# EAGLE board Mk4 Final a (EAGLE 9.0.1), part 2 of 3
## Tracks (layer width: path | path; a pad name or v marks a point on that pad's centre or on a via) (continued)
CC_!HIB  (via drill 0.3) (continued)
  Top 0.15: v30.8,31.2 32.28,31.2 arc45 33.52,31.71 34.87,33.07 arc-45 36.64,33.8 56.85,33.8 arc45 58.09,34.31 60.51,36.73 arc45 60.8,37.44 60.8,37.89 arc-45 60.95,38.25 61.15,38.45 arc45 61.3,38.81 61.3,39.1 arc-90 61.8,39.6 62.69,39.6 arc45 63.39,39.89 63.53,40.03 arc45 63.83,40.74 63.83,40.97 63.8,40.99 arc45 63.62,41.44 63.39,41.66 arc-45 63.1,42.37 63.1,46.46 arc-45 63.02,46.64 63.02,46.86 arc-45 63.1,47.04 63.1,47.29 arc-45 63.25,47.65 v63.9,48.3
  Bottom 0.15: IC15.2 20.55,17.7 arc45 20.69,17.36 21.67,16.38 arc45 21.98,16.25 23.59,16.25 arc45 23.95,16.4 R25.1 24.68,16.37 arc45 25.03,16.23 26.1,16.23 arc90 26.6,16.73 26.6,18.5 arc-45 27.19,19.91 28.61,21.33 arc45 28.9,22.04 28.9,28.89 arc-45 29.19,29.59 v30.8,31.2 | IC1.124 65.02,48.4 arc-45 64.88,48.46 64.88,48.47 arc45 64.73,48.52 64.33,48.52 arc45 63.98,48.38 v63.9,48.3
CC_!RESET  (via drill 0.3)
  Top 0.15: v61,48.5 61,47.95 arc45 61.15,47.6 61.18,47.56 arc-45 61.32,47.21 61.32,47.09 arc-45 61.25,46.9 arc45 61.1,46.55 61.1,46.54 arc-45 60.95,46.19 58.65,43.89 arc90 58.65,42.12 60.11,40.67 arc-45 60.4,39.96 60.4,39.41 arc-45 60.25,39.05 60.05,38.85 arc45 59.9,38.49 59.9,38.22 arc-45 59.31,36.81 57.5,34.99 arc-45 56.79,34.7 36.58,34.7 arc45 34.38,33.85 33.43,32.89 arc-45 32.72,32.6 30.1,32.6 arc-90 29.6,33.1 29.6,33.51 arc90 JP5.4 28.19,34.91 arc45 27.49,35.2 24.93,35.2 arc45 24.58,35.05 24.06,34.53 arc-45 23.74,34.4 arc45 23.38,34.25 23.08,33.95 arc-90 22.72,33.95 21.36,35.31 arc45 20.66,35.6 19.61,35.6 arc45 18.91,35.31 18.29,34.69 arc-45 17.59,34.4 8.7,34.4 arc90 7.2,32.9 7.2,30.34 v7.3,30.24 v7.3,30.25
  Bottom 0.15: IC1.12 61.6,47.69 arc45 61.45,48.05 v61,48.5
  Bottom 0.2: IC15.32 12.55,26.25 12.34,26.46 arc-45 12.05,27.16 12.05,27.5 arc90 11.05,28.5 R73.1 C60.2 arc-90 7.3,29.25 v7.3,30.25
CC_!RTS
  Bottom 0.2: IC15.50 22.84,25.75 arc-45 23.2,25.6 23.45,25.35 arc45 23.81,25.2 25.85,25.2 arc90 26.35,25.7 26.35,25.8 R70.1
CC_IRQ  (via drill 0.3)
  Top 0.15: v14.05,17.44 14.07,17.41 14.07,17.23 16.36,14.94 arc45 17.06,14.65 25.95,14.65 arc90 27.2,15.9 arc-45 27.71,17.14 27.76,17.18 arc45 28.2,18.25 28.2,19.6 arc-45 28.79,21.01 29.92,22.15 arc45 30.36,23.21 30.36,26.02 arc-45 30.66,26.73 35.79,31.86 arc-45 36.85,32.3 57.49,32.3 arc-45 58.19,32.01 58.71,31.49 arc45 59.41,31.2 59.69,31.2 arc45 60.39,31.49 62.01,33.11 arc45 62.3,33.81 62.3,37.68 arc-45 62.74,38.74 63.76,39.76 arc45 64.12,40.64 64.12,41.09 64.1,41.12 arc45 63.92,41.56 63.69,41.78 arc-45 63.4,42.49 63.4,45.44 arc-45 63.69,46.15 63.93,46.39 arc45 64.08,46.74 64.08,47.27 arc-45 64.22,47.62 v64.6,48
  Bottom 0.15: R72.1 14.05,15.75 v14.05,17.44 IC15.15 | IC1.123 66.62,48.8 arc45 66.58,48.78 arc-45 66.44,48.73 66.16,48.73 arc-45 66.02,48.78 65.97,48.84 arc45 65.83,48.9 63.88,48.9 arc90 63.38,48.4 63.38,48.2 arc90 63.88,47.7 64.3,47.7 v64.6,48
CC_RCT_XTAL_N
  Bottom 0.25: C100.2 25.85,21.25 X3.P$1 25.05,21.2 arc-90 24.55,21.7 24.55,23.44 arc45 24.4,23.8 23.95,24.25 arc45 23.59,24.4 23.36,24.4 arc-45 23,24.55 22.95,24.6 arc45 22.59,24.75 IC15.52
CC_RESERVED@19
  Bottom 0.15: IC15.19 12.52,19.75 arc90 12.27,19.5 12.27,18.53 12.8,18.01 R65.1
CC_RTC_XTAL_P
  Bottom 0.25: C101.2 25.85,24.25 X3.P$2 24.71,24.3 arc-45 24.35,24.45 24.12,24.68 arc45 23.77,24.82 23.65,24.82 arc-45 23.3,24.97 23.17,25.1 arc45 22.81,25.25 IC15.51
CC_TEST62
  Bottom 0.15: IC15.62 22.12,19.75 arc-90 22.32,19.55 22.32,17.27 TP19.TP
CC_WLAN_XTAL_
  Bottom 0.15: X4.3 7.67,18.32 8.31,18.96 arc-45 9.01,19.25 9.84,19.25 arc-45 10.54,18.96 C99.2 arc90 11.67,19.68 11.67,20.5 arc-90 12.42,21.25 IC15.22
CC_WLAN_XTAL_P
  Bottom 0.15: X4.1 10.17,19.75 C98.2 arc90 11.37,20.38 11.37,20.75 arc-90 12.37,21.75 IC15.23
DCDC_ANA_SW
  Bottom 0.25: 16.05,30.7 IC15.38
  Bottom 0.4: L7.2 15.4,32.21 arc45 15.69,31.51 15.76,31.44 arc-45 16.05,30.74 16.05,30.7
DCDC_DIG_SW
  Bottom 0.25: IC15.43 18.55,27.79 arc-45 18.84,28.49 19.36,29.01 arc45 19.65,29.71 arc-45 19.92,30.37 20.01,30.46 arc-45 20.71,30.75 23.65,30.75 L9.2
DCDC_PA_SW_N
  Bottom 0.25: IC15.41 17.55,28.29 arc-45 17.84,28.99 18.55,29.7
  Bottom 0.3: 18.55,29.7 18.55,29.76 18.8,30.01 18.8,32 18.9,32.1
  Bottom 0.5: 18.9,32.1 18.9,33.59 arc45 18.75,33.95 18.1,34.6 L8.1
DCDC_PA_SW_P
  Bottom 0.25: IC15.40 17.05,28.55 arc-45 17.34,29.26 18.25,30.17
  Bottom 0.4: L8.2 18.25,32.4 18.25,30.17
EN0RXI_N
  Bottom 0.22: IC1.53 51.21,54.8 51.2,54.81 48.9,54.81 arc-90 46.61,57.1 46.61,64.8 arc-90 50,68.19 56.1,68.19 arc90 57.02,69.1 57.02,69.6 JP7.6
EN0RXI_P
  Bottom 0.22: IC1.54 51.21,55.2 51.2,55.19 48.9,55.19 arc-90 46.98,57.1 46.98,64.8 arc-90 50,67.81 56.1,67.81 arc90 57.38,69.1 57.38,69.23 JP7.7
EN0TXO_N
  Bottom 0.22: IC1.56 51.21,56 51.2,56.02 49.05,56.02 arc-90 47.66,57.4 47.66,64.45 arc-90 50.4,67.19 56.41,67.19 arc45 57.12,67.48 58.33,68.69 arc-45 59.04,68.98 66.16,68.98 arc-45 66.87,68.69 67.83,67.73 arc45 68.54,67.44 70.95,67.44 arc90 72.31,68.8 72.31,69.54 JP7.12
EN0TXO_P
  Bottom 0.22: IC1.57 51.21,56.4 51.2,56.38 49.05,56.38 arc-90 48.03,57.4 48.03,64.45 arc-90 50.4,66.81 56.56,66.81 arc45 57.27,67.11 58.48,68.32 arc-45 59.19,68.61 66.01,68.61 arc-45 66.72,68.32 67.68,67.36 arc45 68.39,67.06 70.95,67.06 arc90 72.69,68.8 72.69,69.29 JP7.13
ETHLED0
  Bottom 0.15: R1.2 44.3,66.51 arc45 44.59,65.81 45.31,65.09 arc-45 45.6,64.39 45.6,61.94 45.69,61.85 arc-90 45.69,61.15 45.6,61.06 45.6,57.19 45.69,57.1 arc-90 45.69,56.4 45.6,56.31 45.6,54.11 arc45 45.89,53.41 46.41,52.89 arc-45 46.7,52.19 46.7,51.4 arc90 47.7,50.4 IC1.42
ETHLED0_R
  Bottom 0.15: R1.1 arc-90 45.3,69 46.89,69 arc45 47.59,69.29 48.37,70.07 JP7.3
ETHLED1
  Bottom 0.15: R2.2 45.3,66.01 arc45 45.59,65.31 45.61,65.29 arc-45 45.9,64.59 45.9,62.07 45.94,62.03 arc-90 45.94,60.97 45.9,60.93 45.9,57.32 45.94,57.28 arc-90 45.94,56.22 45.9,56.18 45.9,54.31 arc45 46.19,53.61 46.81,52.99 arc-45 47.1,52.29 47.1,51.8 arc90 48.1,50.8 IC1.43
ETHLED1_R
  Bottom 0.15: R2.1 45.3,68.2 arc-90 45.8,68.7 47.22,68.7 arc45 47.57,68.85 47.58,68.85 arc-45 47.93,69 51.89,69 arc45 52.59,69.29 53.45,70.15 JP7.5
FET
  Bottom 0.15: IC1.110 68.58,54 arc45 68.65,54.03 68.89,54.27 arc-45 68.97,54.3 71.38,54.3 arc-90 73.38,52.3 73.38,50.38 arc45 73.52,50.02 73.68,49.86 arc-45 73.83,49.51 73.83,49.25 arc45 74.12,48.54 83.03,39.63 arc-45 83.3,38.98 83.3,38
  Bottom 0.2: R59.1 103.21,13.25 arc-45 102.51,13.54 94.59,21.46 arc45 93.89,21.75 88.91,21.75 arc-45 88.21,22.04 83.59,26.66 arc-45 83.3,27.36 83.3,38
  Bottom 0.3: Q2.1 104.72,13.25 R59.1
FET_OUT  (via drill 0.3)
  Top 0.25: LED5.K 38.25,6.82 arc45 38.96,6.53 56.9,6.53 arc-45 57.61,6.23 arc45 58.17,6 61.46,6 arc45 61.96,6.21 arc-45 62.67,6.5 69.89,6.5 arc45 70.59,6.79 72.01,8.21 arc-45 72.71,8.5 83.74,8.5 arc-45 84.44,8.21 v86.15,6.5 | v92.8,6.5 92.89,6.5 arc45 93.59,6.79 99.59,12.79 arc-90 101.01,12.79 101.51,12.29 arc45 102.21,12 105.2,12 arc-45 105.91,11.71 PCB.FET
  Bottom 0.25: v86.15,6.5 v92.8,6.5
  Bottom 0.4: Q2.3 106.72,11.3 arc45 107.02,10.6 108.71,8.91
  Bottom 0.5: 108.71,8.91 PCB.FET
FLASH_!CS  (via drill 0.3)
  Top 0.15: v13.55,12.5 14.03,12.98 arc45 14.32,13.69 14.32,14.73 arc45 14.03,15.44 12.7,16.77 arc-45 12.62,16.95 12.62,17.22 arc45 12.55,17.4 9.11,20.84 arc-45 8.6,22.07 8.6,23.29 arc45 8.31,23.99 5.81,26.49 arc-45 5.3,27.73 5.3,34.48 arc-45 5.81,35.71 8.26,38.16 arc-45 9.5,38.67 11.06,38.67 arc45 11.77,38.97 v12.3,39.5
  Bottom 0.15: JP1.3 9.28,12.5 arc90 10.28,11.5 12.14,11.5 arc45 12.84,11.79 v13.55,12.5 14.08,13.03 arc45 14.37,13.74 14.37,16.94 arc-45 14.43,17.08 14.52,17.16 arc45 14.57,17.3 14.57,17.66 14.55,17.68 IC15.14
  Bottom 0.2: R67.1 10.3,38.22 IC14.1 11.14,38.34 v12.3,39.5
FLASH_!HOLD
  Bottom 0.2: R9.2 69.11,43.75 IC6.7
FLASH_!WP
  Bottom 0.2: IC6.3 77.53,42.52 R10.2
FLASH_CLK  (via drill 0.3)
  Top 0.15: v14.55,40.25 14.55,39.02 arc-90 13.3,37.77 9.56,37.77 arc45 8.85,37.48 6.49,35.12 arc45 6.2,34.41 6.2,27.81 arc45 6.49,27.11 9.29,24.31 arc-45 9.5,23.8 9.5,22.14 arc45 9.79,21.43 13.45,17.77 arc-45 13.52,17.59 13.52,17.32 arc45 13.6,17.15 14.76,15.98 arc-45 15.27,14.75 15.27,13.44 arc45 15.57,12.73 v15.8,12.5 15.8,12 arc-90 14.8,11 9.01,11 arc-90 8.01,12 JP1.4
  Bottom 0.15: IC15.11 16.05,17.84 arc-45 15.76,17.13 15.57,16.94 arc45 15.27,16.23 15.27,13.44 arc45 15.57,12.73 v15.8,12.5
  Bottom 0.2: IC14.6 15.6,40.88 arc45 14.89,40.59 v14.55,40.25
FLASH_MISO  (via drill 0.3)
  Top 0.15: v12.3,40.5 arc-45 12.64,40.36 12.91,40.09 arc-45 13.2,39.39 13.2,39.38 arc-90 12.2,38.38 9.52,38.38 arc45 8.46,37.94 6.04,35.52 arc45 5.6,34.45 5.6,27.75 arc45 6.04,26.69 8.53,24.19 arc-45 8.9,23.31 8.9,22.1 arc45 9.34,21.04 12.85,17.52 arc-45 12.92,17.35 12.92,17.08 arc45 13,16.9 14.26,15.64 arc-45 14.62,14.76 14.62,13.24 arc-45 14.33,12.53 v14.3,12.5 arc-90 13.3,11.5 11.55,11.5 arc-90 10.55,12.5 JP1.2
  Bottom 0.15: 14.3,12.6 v14.3,12.5 14.3,12.71 arc-45 14.38,12.91 arc45 14.67,13.62 14.67,16.48 arc-45 14.97,17.19 arc45 15.05,17.39 IC15.13
  Bottom 0.2: IC14.2 11,39.62 arc45 11.71,39.91 v12.3,40.5
FLASH_MOSI  (via drill 0.3)
  Top 0.15: v15.05,12.5 arc-45 14.92,12.8 14.92,14.78 arc45 14.49,15.84 13.3,17.02 arc-45 13.22,17.2 13.22,17.47 arc45 13.15,17.65 9.57,21.23 arc-45 9.2,22.12 9.2,23.33 arc45 8.76,24.39 6.27,26.88 arc-45 5.9,27.77 5.9,34.43 arc-45 6.27,35.32 8.66,37.71 arc-45 9.54,38.08 13,38.08 arc90 14,39.08 14,40.95 v14.05,41
  Bottom 0.15: 14.97,12.57 v15.05,12.5 | JP1.5 6.74,13.56 9.01,11.29 arc45 9.71,11 13.82,11 arc90 14.82,12 14.82,12.21 arc-45 14.97,12.57 | IC15.12 15.55,17.75 arc-45 15.27,17.07 arc45 14.97,16.36 14.97,12.57
  Bottom 0.2: IC14.5 15.62,42.16 arc45 14.91,41.86 v14.05,41
FLASH_PU
  Bottom 0.15: IC14.3 11.8,40.88 arc45 11.94,40.94 11.97,40.97 arc-45 12.11,41.02 12.31,41.02 arc-45 12.66,40.88 13.63,39.91 arc45 14.34,39.62 IC14.7
  Bottom 0.2: IC14.3 8.43,40.88 R66.2
GMS_ANT_L
  Bottom 0.4: L3.2 C73.2 D2.1 116.05,34.5 J4.ANT J7.1
GND  (via drill 0.3)  (10 unrouted)
  Top 0.15: IC17.3 84.1,10.65 84.05,10.6 IC17.2 | v83.1,9.5 IC17.PAD v83.1,10.5
  Top 0.2: 84.1,10.65 84.75,10.65 v84.85,10.75
  Top 0.3: S8.1 95.75,26.95 S8.A1 | S7.A1 83.25,26.95 S7.1 v84.8,27 | S10.A1 83.25,14 83.5,13.75 v84.8,13.75 S10.1 | S12.1 108.25,14.45 S12.A1 | S9.1 117.35,30.05 S9.A1 | 108.25,51.5 108.25,51.95 S3.1 v111.3,53.5 | 108.25,51.5 S3.A1 | S2.A1 95.75,51.95 S2.1 97.8,54 v98.8,54 | S1.A1 83.25,51.95 S1.1 86.05,53.5 v86.3,53.25 | S4.A1 83.25,39.45 S4.1 v86.3,41 | 95.75,39 95.75,39.45 S5.1 v95.85,41 | 95.75,39 S5.A1 | S1.A2 92.35,52.8 v92.55,53 | 108,51.25 108.25,51.5 | S6.A2 v112.8,38.75 | v111.3,41 S6.1 108.25,39.45 S6.A1 S5.A2 | 92.3,26.3 S7.A2 90.3,26.25 v89.8,26.75 | S8.1 96.8,29 | S12.A2 117.3,13.75 117.3,13.25 v118.05,12.5 | S11.A2 S12.A1 | v98.8,16 S11.1 95.75,14.45 S11.A1 S10.A2 | S4.A2 95.5,38.75 95.75,39 | S17.1 85.29,69.01 v84.8,69.5 | LED3.C v59.82,73.75 LED4.C | LED1.3 49.75,78 v48.55,78 | S3.A2 113.71,51.25 arc-45 113.01,51.54 v112.8,51.75 | 15.41,46.39 S13.A1 14.3,45.27 v14.3,45 13.42,45.88 S13.1 | S13.A2 9.37,53.21 arc-45 10.08,53.5 v10.3,53.5 | S12.A1 v109.8,13.75 | S2.A2 104.85,50.7 v105.8,49.75 | S8.1 97.05,28.75 v95.8,28.75 | S8.A2 105.3,25.8 v105.3,25 | S14.A2 v16.05,56.5 | S14.1 25.15,54.55 S14.A1 v25.15,56.5 | S16.1 26.3,66.72 v26.3,65.75 | S15.A1 28.61,43.19 v27.8,44 28.48,44.68 S15.1 | v34.3,48.5 35.41,49.61 S15.A2 | LED2.3 64.85,77.36 arc45 65.14,76.66 v65.2,76.6 | S9.A2 109.3,31.8 v109.3,32 | S9.A1 117.35,29.95 v117.8,29.5 | S9.A1 117.33,30.77 J7.G@4
  Top 0.4: S6.A2 117.33,38.73 J7.G@3
  GND@3 0.4: v22.25,28.85 19.6,26.2 v19.6,25.85 | v17.3,31.5 16.55,30.75 16.55,26.6 v17.3,25.85 | v14.8,31.1 15.55,30.35 15.55,26.4 v16.1,25.85
  Bottom 0.15: J2.32 56.55,38.25 | J2.31 57.05,38 | J2.30 57.55,38 | J2.29 58.05,38 | J2.28 58.55,38 | J2.27 59.05,38 | J2.26 59.55,38 | J2.25 60.05,38 | J2.24 60.55,38 | J2.23 61.05,38 | J2.22 61.55,38 | J2.21 62.05,38 | J2.20 62.55,38 | J2.19 63.05,38 | J2.18 63.55,38 | J2.17 64.05,38 | J2.16 64.55,38 | J2.15 65.05,38 | J2.14 65.55,38 | J2.13 66.05,38 | J2.12 66.55,38 | J2.11 67.05,38 | IC1.58 v53.4,56.8 | IC1.55 v53.4,55.6 | IC7.3 74.85,74 v74.65,74.2 | ANT2.3 106.59,71.9 v105.95,71.9 | v105.5,70.75 105.6,70.65 105.74,70.65 105.64,70.75 v105.5,70.75 | ANT2.2 105.85,70.4 v105.5,70.75 | ANT2.4 110.08,70.2 v110.55,70.2 | IC15.PAD v17.9,23.1 | IC15.PAD v16.7,23.1 | IC15.PAD v16.7,21.9 | IC15.PAD v17.9,21.9 | v16.7,24.3 17.3,24.9 v17.3,25.85 | v16.1,25.85 16.1,24.9 v15.5,24.3 15.55,24.35 | v19.1,24.3 19.1,25.35 v19.6,25.85 | v75.3,18.75 C102.2 75.8,19.5 arc90 76.3,20 76.3,20.5 arc90 75.8,21 IC16.2 75.26,21 arc45 74.9,20.85 74.7,20.65 arc-45 74.34,20.5 IC16.4 | C104.2 84.25,10.5 | v101.05,66 C54.2 | C57.2 v101.05,65 | C55.2 v94.55,66 | C53.2 v94.55,65 | v18.35,55.4 18.05,55.7 R74.2
  Bottom 0.2: C13.1 62.4,43.85 IC1.10 | IC1.17 59.6,44.01 arc-45 59.45,43.65 C12.1 v59.3,42.75 | IC1.48 51.26,52.8 arc-45 C10.1 | IC1.114 68.54,52.4 arc45 69.24,52.69 C9.1 | IC1.80 59.6,62.05 59.77,62.23 | X4.4 7.67,21.43 7.5,21.6 v6.7,21.6 | X4.2 9.52,17.07 v9.6,17 | IC4.23 75.6,26.75 arc-45 75.46,26.81 75.05,27.22 arc-90 75.05,27.25 | 75.05,27.25 v75.05,27.5 | IC4.24 75.05,27.25 | IC4.18 76.8,23.25 v76.55,23 | IC4.9 v81.05,26.25 | IC8.17 40.3,21.5 v39.8,21 IC8.18 | J1.GND4 110.8,16.05 | 84.25,10.5 arc45 v84.85,10.75 | v25.1,57.5 C106.2 | IC11.4 81.77,57.73 C78.1
  Bottom 0.25: J2.50 47.55,37.45 v48.05,37.95 | J2.49 v48.05,37.95 | J2.48 48.55,37.45 v48.05,37.95 | J2.43 51.05,38 | J2.6 v69.55,35.5 | v61.8,40.75 61.8,41.62 C14.1 62.05,42.12 C13.1 | v49.8,53.1 C10.1 | v70.05,52.75 C9.1 | v59.8,63 C11.1 59.77,62.23 | C8.1 C16.1 v60.8,64.45 | v48.8,57.25 R3.2 | C15.1 58.85,64.25 v59.45,63.65 | v69.3,8.25 S19.1 | v45.3,8.25 S20.1 | C19.1 v56.5,63 | C18.1 v51.9,63 | v65.3,64.45 C17.1 | R71.2 v19.05,15.75 | v21.15,53.95 IC13.PAD v20.6,53.5 | C46.2 32.67,15.22 | v79.25,71 C5.1 | v62.3,74 C3.1
  Bottom 0.3: 71.25,74.3 v71.95,73.6 | v25.8,27 R70.2 | v8.05,30.25 C60.1 | v10.3,31 10.42,30.88 C86.2 | v90.3,43.25 C69.2 | v89.3,43.25 C66.2 | v90.3,49.75 C65.2 | C67.2 v89.3,49.75 | IC5.8 93.9,42.65 v94.05,42.5 | R40.2 v88.55,40.25 | R38.2 v88.55,34.25 | R39.2 v88.55,36.25 | IC5.13 95.9,48.65 v96.05,48.5 | IC5.21 104.7,48.65 v104.55,48.5 | Q1.2 88.45,30.15 R30.2 v87.55,30 | C78.1 v81.8,58.5 | v85.8,60 85.71,60.09 JP4.5 | C71.1 v93.55,61.5 | IC12.7 86.99,49.81 R55.1 v87.05,49 | v95.3,53 C50.1 | v98.8,54 98.3,53.5 C49.1 | C48.1 v101.3,54 | J1.GND3 105.01,26.06 arc-45 105.3,25.36 v105.3,25 | 117.17,28.5 J1.GND2 117.3,28.59 arc-45 117.59,29.29 v117.8,29.5 | 117.97,26 J1.C4 117.59,25.74 arc45 117.3,25.04 v117.3,25 | v118.3,17 118.17,17 J1.GND1 | v103.05,14.25 R59.2 104.72,14.25 Q2.2 | C51.1 v114.55,13.5 | J1.C5 110.65,17.65 v110.8,17.5 110.8,16.05 | v102.8,17.5 103.03,17.27 104.05,17.27 J1.GND6 | C2.1 v70.05,47 | C7.1 v72.8,50.25 | C6.1 v72.8,51.5 | Q8.4 Q8.EP2 | C28.1 v45.3,42.25 | IC2.28 30.87,42.25 v31.8,42.25 | C24.1 v27.8,54.25 | IC2.46 32,56.7 v32.05,56.75 | C27.1 v27.8,59 | IC2.54 31.69,63.1 arc45 v32.05,63.25 | IC2.52 v32.05,61.5 | C26.1 v44.55,63.75 | C22.1 v45.3,61.5 | IC2.6 41.2,59.1 v41.05,59.25 | C23.1 v45.3,56.75 | C25.1 v45.3,52.75 | R15.1 v46.8,23.25 | R17.2 v46.8,24.25 | R19.2 41.95,29.5 arc45 v42.55,29.75 | v25.8,40 C42.1 | v26.55,40 26.55,39.5 C42.1 | v25.05,40 25.05,39.5 C42.1 | IC2.12 41.1,54.3 v41.05,54.25 | R63.2 v9.05,36.45 | R64.2 v10.05,36.45 | R51.2 v78.8,48.5 | v19.85,48.95 C58.2 | v102.55,48.5 102.5,48.55 IC5.19 102.5,51.2 v102.55,51.25 | R61.2 29.75,15.5 v30,15.75 | IC4.25 v77.3,26 | v60.4,66.55 60.47,66.55 X2.4 | X2.2 64.62,66.55 v64.75,66.55
  Bottom 0.3: v76.3,75.5 C20.1 | v78.4,77.5 R7.2 | C4.1 v70.55,68.5 | C70.1 v77.7,50.45 | J10.8 J10.4 | J8.8 J8.4 | IC2.41 29.85,52.7 v29.8,52.75 | J1.GND5 110.91,28.91 v111.3,29.3 110.74,29.3 arc-45 110.03,29.59 IC10.3 | IC5.33 107.1,34.95 v106.8,35.25 | v111.25,39.6 C72.1 | v110.5,34.5 D2.2 | v110.5,35.5 C73.1 | v5.55,24.75 C76.1 | v2.3,24.75 C77.1 | 26.35,30.8 C87.2 25.75,30.8 | IC3.2 v84.4,7 | C107.2 v78.4,6 | IC3.3 v84.4,6 | v106.8,37.25 106.9,37.15 IC5.31
  Bottom 0.35: v26.35,30 26.35,30.8 | v25.75,30 25.75,30.8
  Bottom 0.4: C89.2 21.9,28.5 v22.25,28.85 | v25.05,27.5 C61.2 | v25.8,25.75 C95.2 | C84.2 21.92,33.62 v22.05,33.5 | C84.2 v21.05,34.75 | v19.8,34.75 C85.2 C84.2 | C90.2 16.7,30.9 v17.3,31.5 17.2,31.4 | C88.2 v14.8,31.1 | v13.3,31.4 13.9,30.8 C44.2 | v28.3,22.25 C100.1 | v28.3,23.25 C101.1 | v26.05,18.75 C96.2 | C92.2 v23.8,21 | C59.1 v15.55,37.25 | C98.1 v10.75,21.5 | C94.2 v10.05,22.25 | C62.2 v10.05,23.25 | C99.1 v10.75,17 | R62.2 v11.8,15.5 | R65.2 v12.8,15.5 | R72.2 v13.8,13.75 | C97.2 v16.8,13.75 | C91.2 v15.8,13.75 | v26.3,28.75 C93.2 25.2,29.64 arc45 v25.05,30 | IC14.4 8.92,42.16 arc45 v8.55,42 | v26.05,16.75 R25.2 | v73.3,26.5 C21.1 | v38.05,18.5 38.65,18.5 C40.2 38.65,19.5 v38.05,19.5 | S18.2 59.2,9 v60.05,9 | Q8.EP2 74.2,37.35 v74.3,37.25 | v74.3,41.25 v74.3,41.24 IC6.4 | 36.55,28.75 C41.2 36.17,28.25 v35.3,28.25 | 36.42,29 v35.3,29 | C36.2 35.4,27.4 v35.3,27.5 | v35.05,25.25 35.05,24.32 C39.1 | 0.8,21.6 v0.8,21.75 ANT1.4 | ANT1.3 v0.8,16.75 | ANT1.2 2.05,17.7 v2.05,16.75 | C43.1 v25.8,13 | C43.1 25.3,13.75 v25.8,13.75 | C43.1 25.3,12.25 v25.8,12.25 | J9.4 28.74,71.81 v28.3,72.25 | C1.2 53.67,74.62 v53.55,74.75 | IC18.3 87.06,8.15 arc-45 86.36,8.44 C108.2 85.48,8.68 arc-45 v85.05,8.5 | TP17.TP 31.55,20.1 v31.4,19.95
  Bottom 0.5: v12.15,36.05 12.15,35.5 C63.2 11.15,35.5 v11.15,36.05
  Bottom 1: J5.1 80.85,14.8 C34.2 | C34.2 79.4,14.85 v79.3,14.75 | C34.2 v80.8,13.5 | v46.15,20 C35.2 44.45,18.85 v44.55,18.75
  other vias: 57.05,38.25 66.55,38.25 50.7,41.15 20.6,54.4 20.05,53.95 110.5,48.1 110.15,44.35 109.8,68 109.3,66.5 108.8,65 107.3,65 105.8,65.5 104.8,65.75 104.05,67 104.55,68.25 105.05,69.75 15.5,23.1 15.5,21.9 15.5,20.7 16.7,20.7 17.9,20.7 19.1,20.7 19.1,21.9 19.1,23.1 17.9,24.3 10.8,27.25 10.8,24.35 6.8,19.2 6.05,16.75 5.05,16.75 4.05,16.75 3.05,16.75 5.8,21.75 4.8,21.75 3.8,21.75 3,21.75 78.8,26 78.05,26.75 78.05,25.25 89.05,27.5 89.05,26.75 113.8,30 112.8,40.75 112.8,42.65 112.8,44.75 112.8,46.75 112.8,52.75 112.8,54.75 112.8,56.75 112.8,61.25 112.8,62.85 116.2,62.85 118.2,62.85 41.05,24 41.8,24 41.05,24.75 41.05,23.25 40.3,24 23.1,48.95 18.35,48.95 18.35,51.45 22.85,51.55 22.85,55.45 31.5,14.85 31.5,14.35 31.5,13.35 31.5,13.85 30.7,12.25 31.4,12.25 30.4,19.95 30.3,18.95 30.3,16.75 30.3,17.55 14.55,23.1 14.55,21.9 14.55,20.7 14.55,24.3 20.05,23.1 20.05,21.9 20.05,20.7 20.05,24.3 15.5,19.75 16.7,19.75 17.9,19.75 19.1,19.75 15.5,25.25 16.7,25.25 17.9,25.25 19.1,25.25 20.05,19.75 20.05,25.25 14.55,25.25 14.55,19.75 18.5,25.85 15,25.85 13.95,25.85 13.95,24.8 17.3,19.15 18.5,19.15 19.7,19.15 16.1,19.15 15,19.15 20.65,22.45 20.65,21.25 20.65,20.05 20.65,23.65 13.95,22.5 13.95,21.3 13.95,20.2 13.95,23.7 20.65,24.75 20.65,25.85 20.65,19.15 13.95,19.15 114.5,32 113.5,32 115.3,30 109.8,38.2 4.3,58 4.3,51 7.3,58.5 7.3,62.5 9.8,62.5 6.8,68.5 2.3,63.5 0.8,58 0.8,49.5 5.8,47.5 7.05,38.25 0.8,24.5 97.8,35.25 94.8,35.25 94.8,37.25 94.8,41.25 101.8,41.25 104.5,46.1 101.8,46.75 107.8,48.75 111.3,33.5 111.05,36.5 112.8,58.25 112.8,59.75 110.8,63.85 112.8,68.35 117.3,64.85 114.3,68.35 109.65,34.95 112.8,33.5 6.4,24.95 7.15,22.45 7.65,22.95 9.8,24.7 8.8,26.7 9.8,26.7 7.9,26.6 110.05,62.5 108.05,62.5 110.05,61 108.05,61 110.05,59.5 108.05,59.5 110.05,58 108.05,58 110.05,56.5 108.05,57 106.55,55 106.05,52.75 105.3,52.5 107.55,53 108.3,53.25 109.8,55 5.55,36.5 3.8,24.15 0.8,22.85 97.8,46.25 97.8,42.5 97.8,43.9
  pour GND@3 (isolate 0.254, rank 6): 0,62.5 0,9 arc31 31.8,0 34.5,0 arc90 37.3,2.8 arc-90 39.3,4.8 80.3,4.8 arc-90 82.3,2.8 arc90 85.1,0 87.8,0 arc31 119.6,9 119.6,32.5 113.3,32.5 113.3,62.5 119.6,62.5 arc64 113.05,70.25 arc24 59.8,80.5 arc24 6.55,70.25 arc55
  pour Bottom (rank 6): 67.05,36.9 67.05,38.25 66.8,38.5 56.8,38.5 56.55,38.25 56.55,36.9
  pour Bottom (isolate 0.254, rank 6): 0,62.5 0,16 arc9 10.8,11 10.8,23 12.8,23 12.8,29 10.8,29 10.8,31 arc90 9.8,32 8.8,32 arc-90 7.8,33 7.8,53.71 arc-90 20.59,66.5 28.3,66.5 31.8,70 90.3,69.5 arc-90 92.8,67 92.8,32.5 103.89,32.5 arc-45 104.59,32.21 107.01,29.79 arc45 107.71,29.5 119.6,29.5 119.6,32.5 113.3,32.5 113.3,62.5 119.6,62.5 arc64 113.05,70.25 arc24 59.8,80.5 arc24 6.55,70.25 arc55
  pour Bottom (rank 2, no thermals): 101.3,33 102.8,33 102.8,30.5 102.21,30.5 arc45 101.51,30.21 101.09,29.79 arc45 100.8,29.09 100.8,27 arc-90 99.8,26 89.3,26 arc-90 88.3,27 arc-90 89.3,28 97.55,28 arc90 98.55,29 98.55,29.09 arc-45 98.84,29.79 99.51,30.46 arc-45 100.21,30.75 100.39,30.75 arc45 101.09,31.04 101.3,31.25
  pour Bottom (no thermals): 51.3,39.5 51.3,38.2 51.1,38 51,38 50.8,38.2 50.8,39.25 50.3,39.75 50.3,41.3 50.5,41.5 50.85,41.5 51.05,41.3 51.05,39.75
  pour Bottom: 23.35,48.95 23.35,54.95 arc90 22.35,55.95 18.85,55.95 arc90 17.85,54.95 17.85,48.95 arc90 18.85,47.95 22.35,47.95 arc90
  pour Bottom (no thermals): 37.2,27 37.2,28.1 37,28.3 37,29.05 36.8,29.25 35.55,29.25 35.05,28.75 35.05,27.25 35.3,27
  pour Bottom (no thermals): 31.7,14.8 31.7,12.3 arc-90 31.2,11.8 30.25,11.8 arc-90 29.75,12.3 29.75,19.65 arc-90 30.25,20.15 31.35,20.15 arc-90 31.85,19.65 31.85,16.1 arc90 32.35,15.6 33.6,15.6 33.65,15.55 33.65,14.9 33.55,14.8
  pour Top (rank 6): 0,39 0,16 arc34 36.8,7 37.3,7 37.3,39
GSM_ANT
  Bottom 0.4: L3.1 C72.2 111.06,37.6 arc45 110.36,37.31 109.39,36.34 arc-45 108.69,36.05 IC5.32
HDC_INT  (via drill 0.3)
  Top 0.15: v78.4,52.8 79.01,53.41 arc45 79.3,54.11 79.3,54.9 arc90 78.3,55.9 76.25,55.9 arc-45 76.11,55.96 76,56.07 arc45 75.86,56.12 75.34,56.12 arc45 75.2,56.07 75.09,55.96 arc-45 74.95,55.9 70.55,55.9 arc45 70.2,55.75 70.06,55.62 arc-45 69.71,55.48 69.24,55.48 arc-45 68.53,55.77 67.59,56.71 arc-45 67.3,57.41 67.3,57.53 arc45 67.01,58.23 66.11,59.13 arc45 65.76,59.27 arc-45 65.53,59.37 v65.4,59.5 | v69.3,24.6 arc-45 69.41,24.87 69.68,25.14 arc45 69.83,25.49 69.83,25.72 arc-45 69.97,26.07 71.91,28.01 arc-45 72.61,28.3 73.59,28.3 arc45 74.29,28.59 76.51,30.81 arc45 76.8,31.51 76.8,34.7 arc-45 76.83,34.77 76.9,34.83 arc45 76.92,34.9 76.92,40.81 arc-45 77.22,41.52 v78.6,42.9
  3V3@2 0.15: v78.6,42.9 78.6,45.2 76.9,46.9 76.9,52 77.8,52.9 78.3,52.9 v78.4,52.8
  Bottom 0.15: IC3.4 79.92,6 arc90 79.67,5.75 79.67,5.6 arc-90 79.42,5.35 78.6,5.35 arc-90 77.6,6.35 77.6,6.79 arc-45 77.89,7.49 78.14,7.74 arc-45 78.28,7.8 78.32,7.8 arc45 78.46,7.86 79.66,9.06 arc45 80.1,10.12 80.1,11.85 arc90 78.35,13.6 75.22,13.6 arc-45 74.33,13.97 69.37,18.93 arc-45 69,19.82 69,23.89 arc-45 v69.29,24.59 v69.3,24.6 | IC1.95 65.6,59.98 arc-45 v65.4,59.5
HEADSET_DET  (via drill 0.3)  (1 unrouted)
  Top 0.15: v24.8,72.75 arc-45 25.4,73 29.89,73 arc45 30.59,73.29 34.01,76.71 arc-45 34.71,77 46.89,77 arc-45 47.59,76.71 48.01,76.29 arc-45 48.3,75.59 48.3,72.91 arc45 48.59,72.21 49.35,71.45 arc-45 49.64,70.75 49.64,69.57 arc45 49.93,68.87 51.4,67.4 arc-45 51.49,67.19 v51.49,65.62
  3V3@2 0.15: v51.49,65.62 51.49,63.59 51.1,63.2 51.1,62.3 51.6,61.8 56,61.8 56.7,61.1 56.7,59.8 57.7,58.8 68.32,58.8 arc45 v68.8,59
  Bottom 0.15: IC1.98 68.32,58.8 arc45 v68.8,59
  Bottom 0.4: J9.7 24.22,72.17 v24.8,72.75
I2C4_SCL  (via drill 0.3)
  Top 0.15: v63.8,26.1 63.8,26.3 63.09,27.01 arc45 62.39,27.3 53.01,27.3 arc45 52.31,27.01 v51.9,26.6 51.58,26.92 arc90 50.52,26.92 v50.2,26.6 | v77,18.8 77,16.14 arc45 77.29,15.43 79.81,12.92 arc-45 80.1,12.21 80.1,11.71 arc45 80.39,11.01 v81.15,10.25 81.26,10.36 arc-45 81.96,10.65 IC17.4
  3V3@2 0.15: v46.8,46.7 46.1,47.4 46.1,51.8 46.35,52.05 46.35,54.55 46.8,55 48.8,55 51.2,57.4 53.75,57.4 54.3,56.85 54.85,56.85 55.3,57.3 v55.3,57.4
  Bottom 0.15: IC8.5 41.8,26.3 arc-90 42.8,27.3 45.18,27.3 arc-45 46.07,26.93 46.31,26.69 arc45 47.01,26.4 49.92,26.4 arc45 50.06,26.46 v50.2,26.6 | IC4.19 74.55,24.75 | IC16.1 76.05,21.5 76.08,21.52 | 76.08,21.52 arc90 76.08,22.23 74.84,23.46 arc-45 74.55,24.16 74.55,24.75 | 74.55,24.75 71.96,24.75 arc-45 71.26,25.04 70.49,25.81 arc45 69.79,26.1 v63.8,26.1 | v51.9,26.6 51.5,27 51.5,30.38 arc45 51.13,31.27 46.79,35.61 arc-45 46.5,36.31 46.5,45.99 arc-45 v46.79,46.69 v46.8,46.7 46.85,46.75 R22.1 | v77,18.8 77,20.39 arc45 76.85,20.75 76.08,21.52 | IC1.61 54.49,58 arc-45 54.85,57.85 v55.3,57.4 | IC3.6 80.52,8.88 arc45 80.5,8.95 80.43,9.02 arc-45 80.4,9.09 80.4,9.29 arc-45 80.55,9.65 v81.15,10.25
I2C4_SDA  (via drill 0.3)
  Top 0.15: v71.8,24 v71.8,25.5 | v62.38,26.7 53.34,26.7 arc45 52.63,26.41 52.35,26.13 arc-45 51.8,25.9 arc-90 v51.1,26.6 | IC17.6 v81.15,9.35 80.8,9.35 arc-90 79.8,10.35 79.8,12.09 arc45 79.51,12.79 73.79,18.51 arc45 73.09,18.8 v72.6,18.8
  3V3@2 0.15: v45.8,46.7 45.8,52 46.05,52.25 46.05,54.75 46.8,55.5 48.8,55.5 51.05,57.75 54.15,57.75 v54.5,57.4
  Bottom 0.15: IC8.6 arc-90 43.25,27 45.16,27 arc-45 45.87,26.71 46.11,26.47 arc45 46.99,26.1 49.62,26.1 arc-45 49.76,26.04 49.84,25.96 arc45 49.98,25.9 50.4,25.9 arc90 v51.1,26.6 51.2,26.7 51.2,30.34 arc45 50.91,31.04 46.49,35.46 arc-45 46.2,36.16 46.2,45.89 arc45 45.91,46.59 v45.8,46.7 arc45 45.9,46.94 45.9,47.7 R21.1 | IC4.20 74.72,25.25 74.69,25.23 72.46,25.23 arc-45 v71.8,25.5 71.19,26.11 arc45 70.49,26.4 64.51,26.4 arc-45 64.15,26.55 64.15,26.55 arc45 63.79,26.7 v62.38,26.7 | IC16.6 73.96,21.5 arc-45 73.26,21.79 72.6,22.45 | 72.6,22.45 72.09,22.96 arc-45 71.8,23.66 v71.8,24 | v72.6,18.8 72.6,22.45 | IC1.60 54.09,57.6 arc-45 54.45,57.45 v54.5,57.4 | IC3.1 83.27,8.06 arc45 82.98,8.77 82.69,9.06 arc45 81.99,9.35 v81.15,9.35